# Altium schematic sheet 控制板.SchDoc (part 1 of 2) (continued)
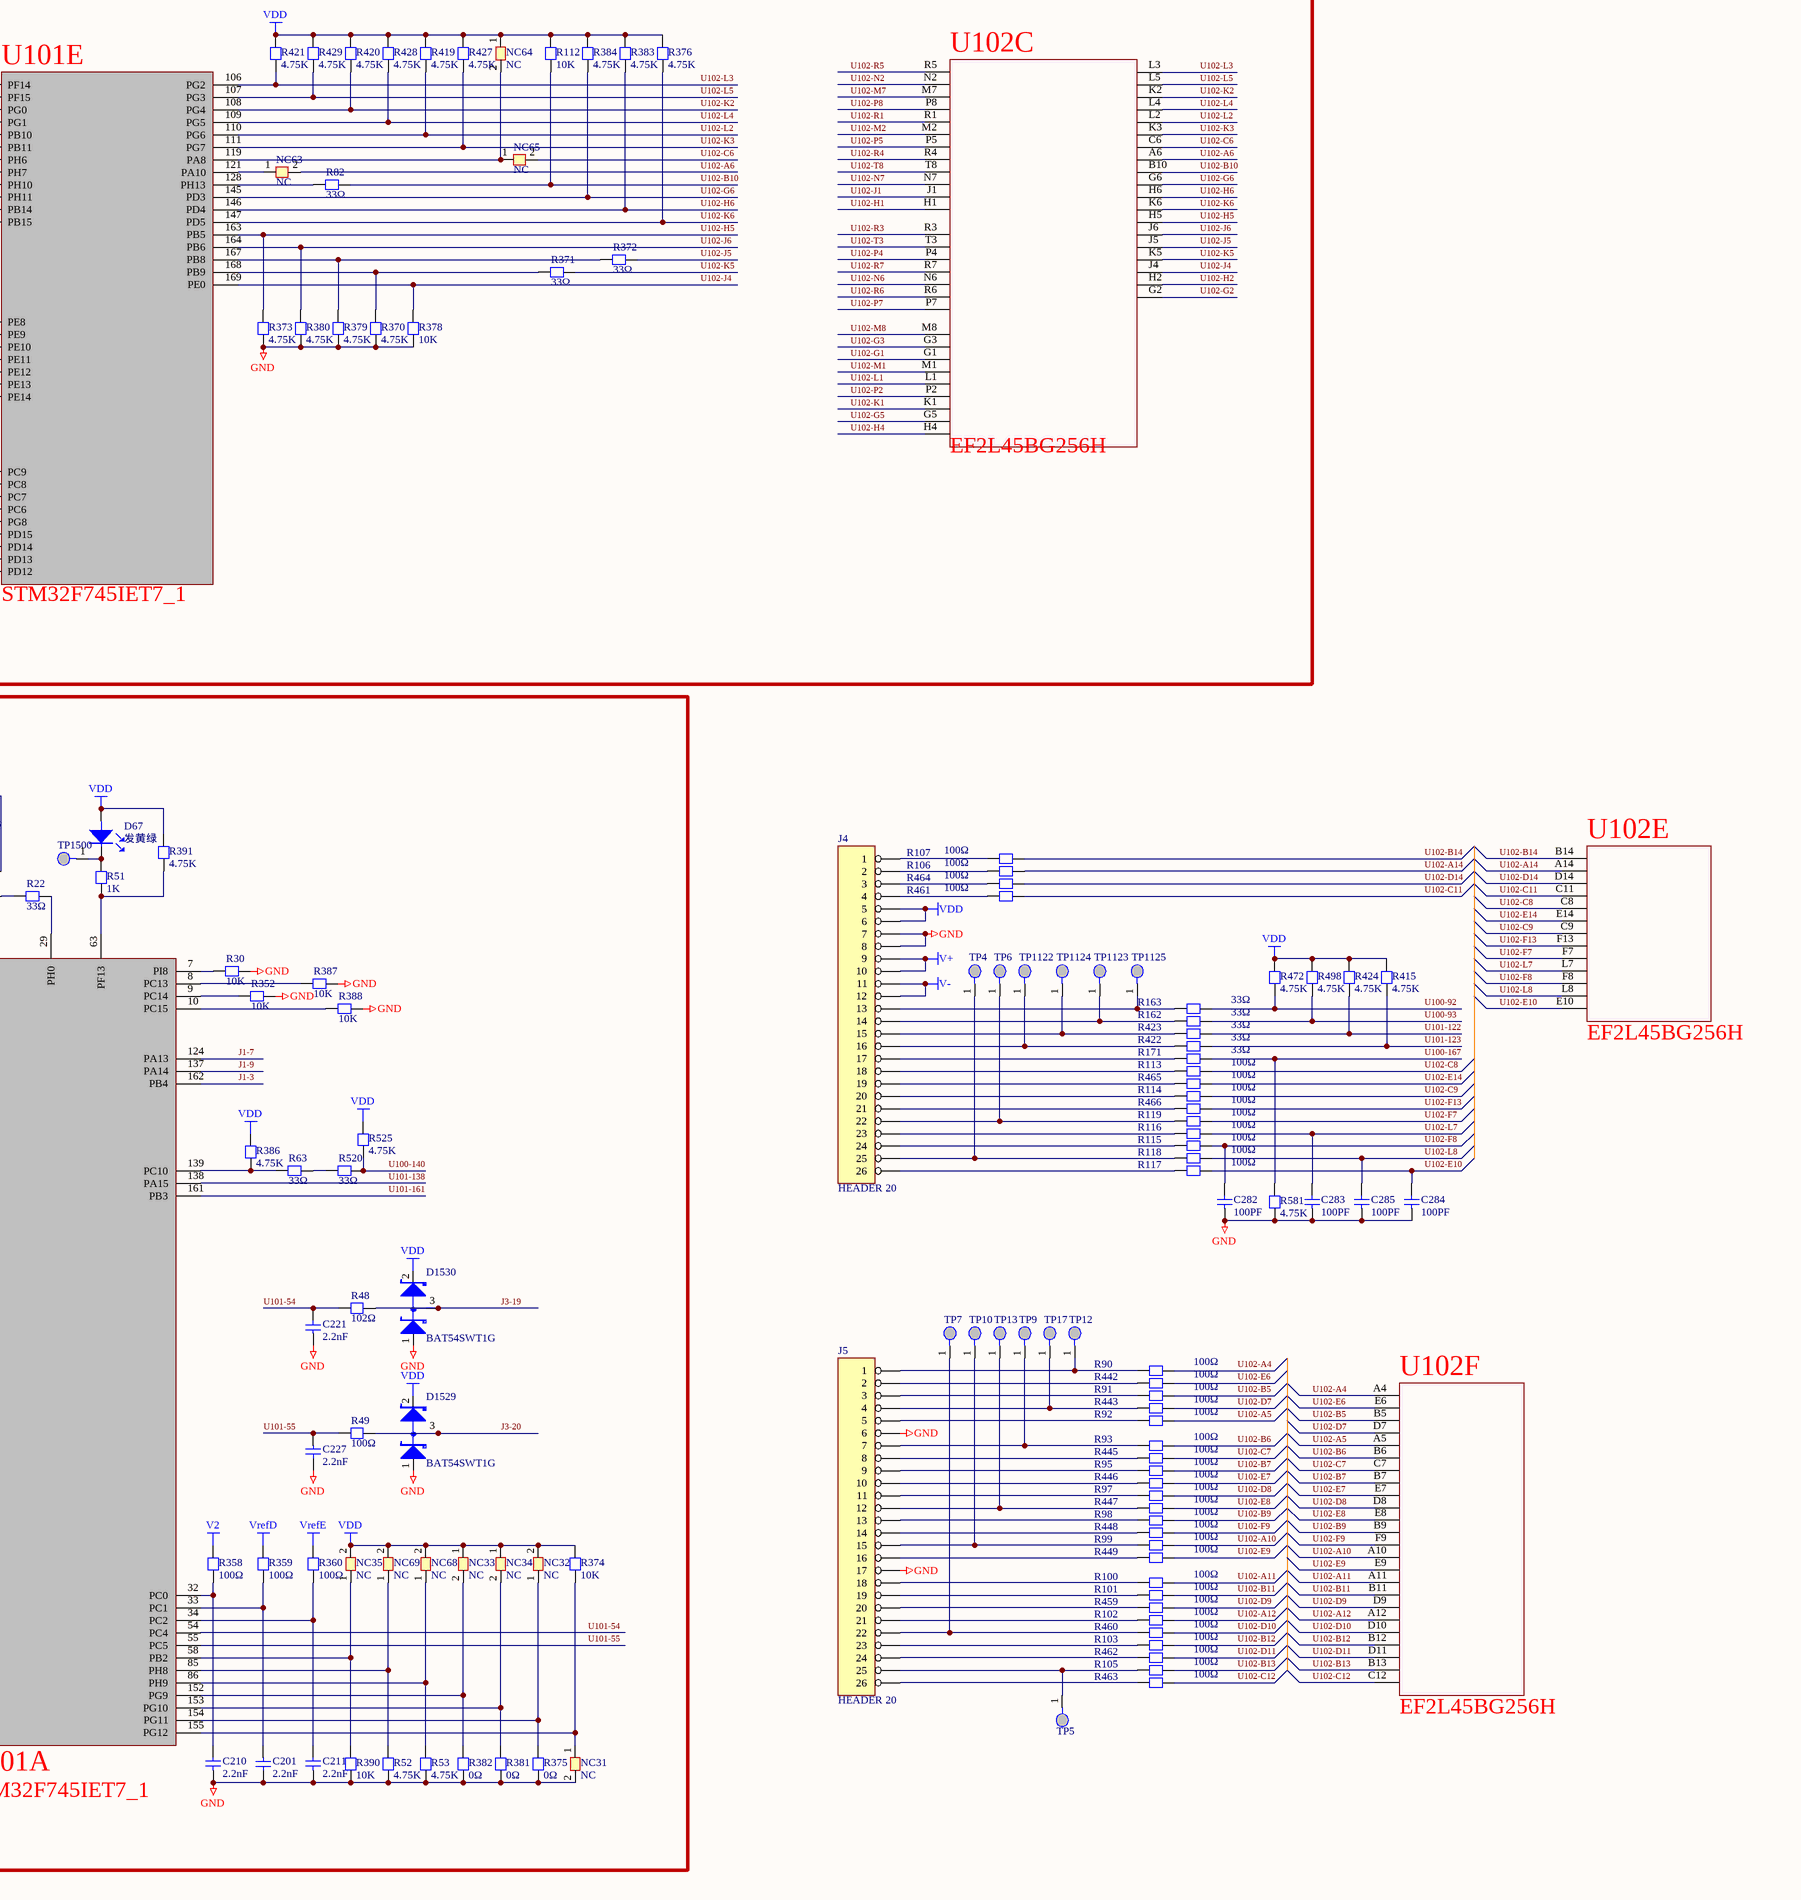
[diagram p10: 控制板.SchDoc, bottom column 3 of 4]
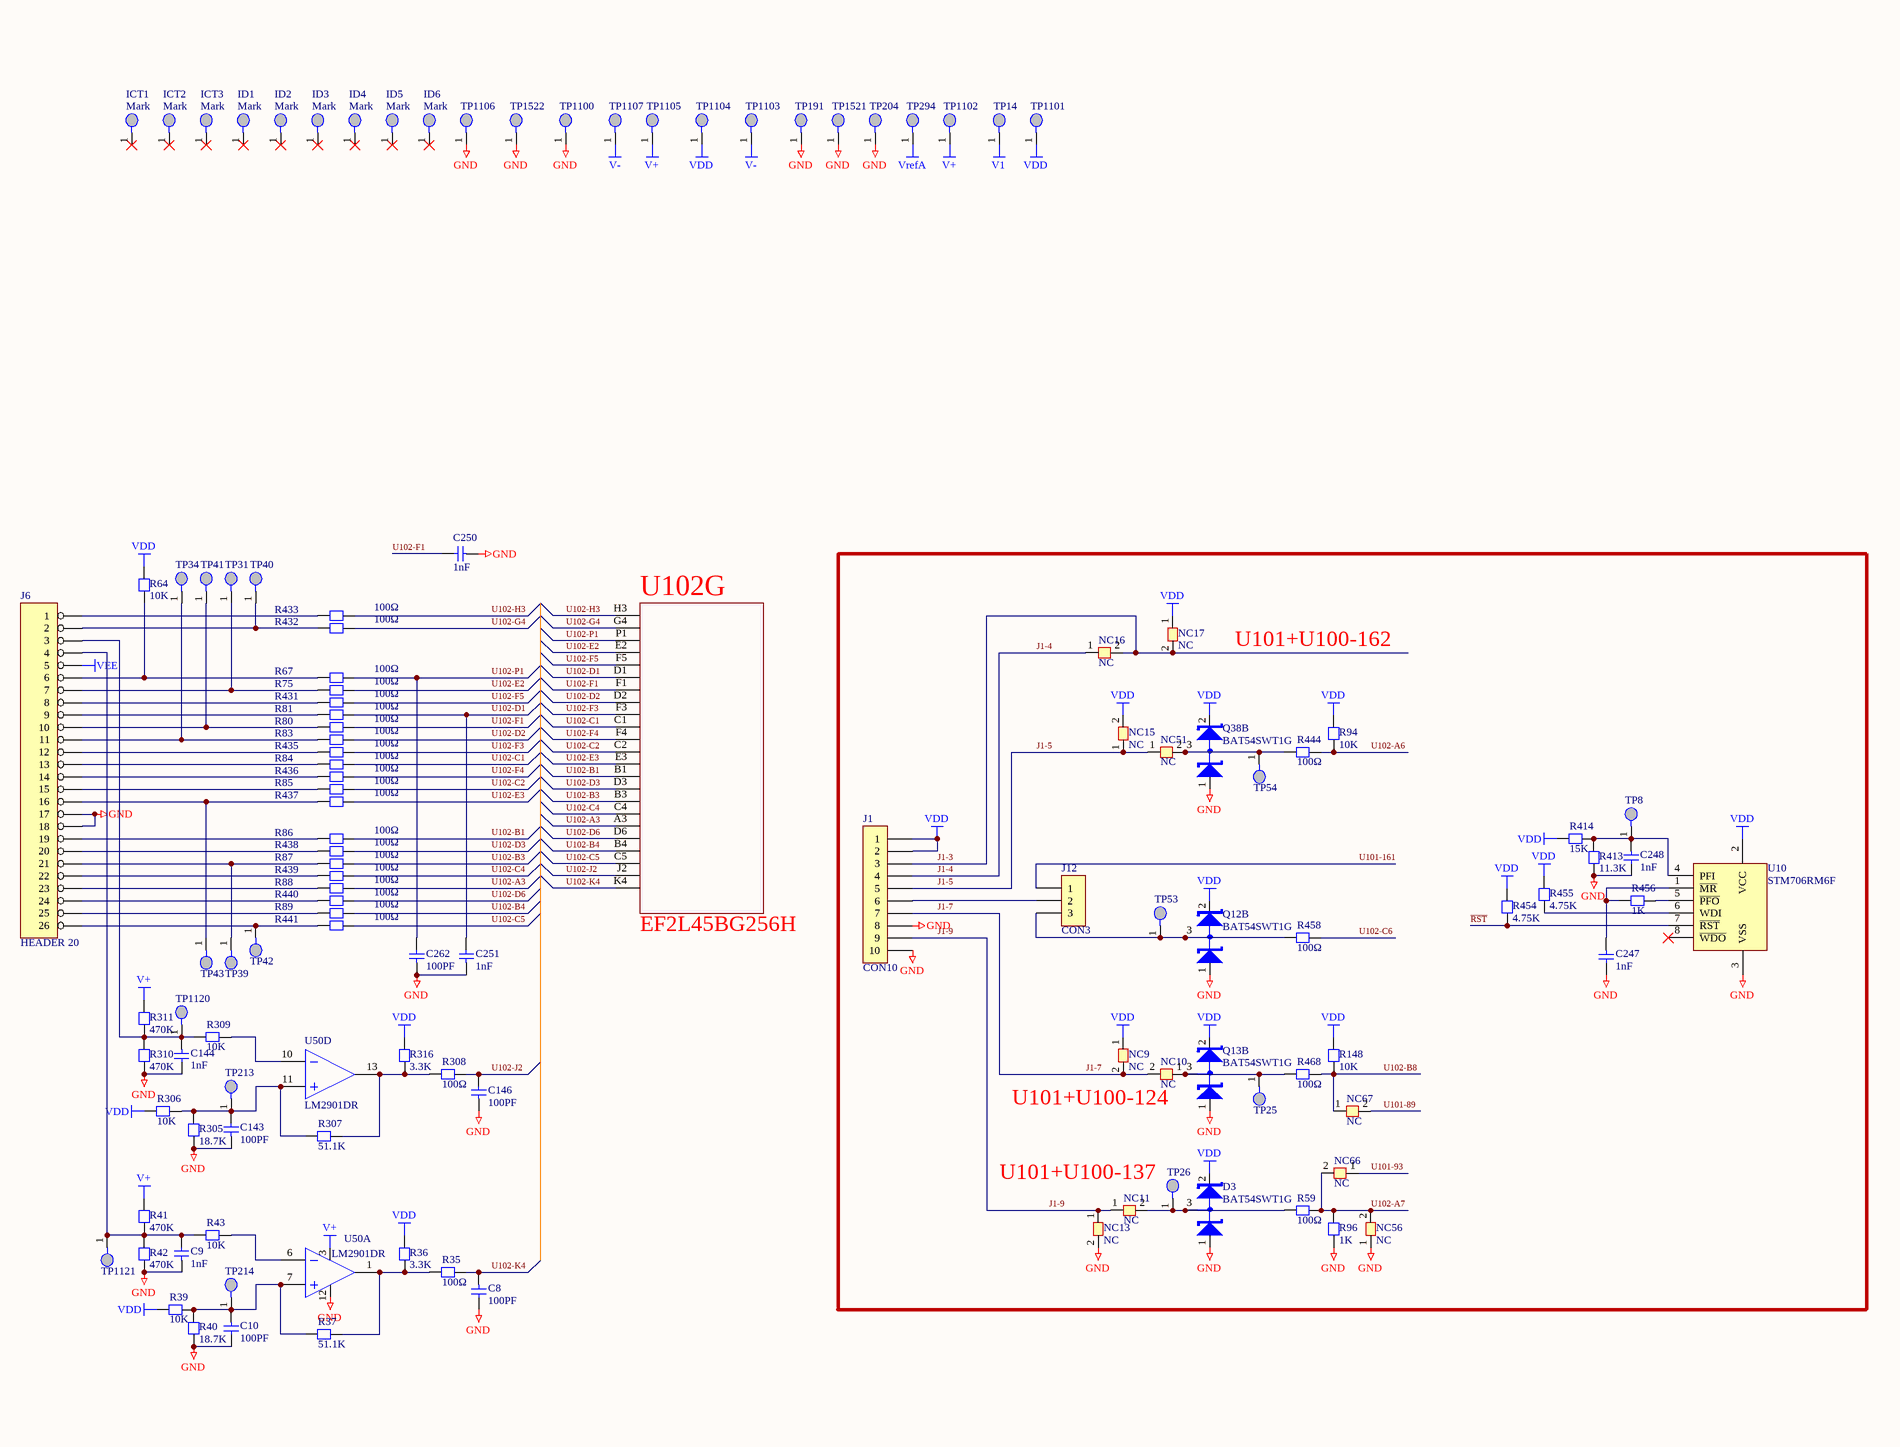
[diagram p11: 控制板.SchDoc, bottom column 4 of 4]

## Parts
C1  10uF
C2  10uF
C3  10uF
C4  100nF
C5  1uF
C6  1nF
C7  1nF
C8  100PF
C9  1nF
C10  100PF
C11  6.8uF
C12  100nF
C13  6.8uF
C14  100nF
C15  100nF
C16  100nF
C17  6.8uF
C18  1uF
C19  100nF
C20  10nF
C21  1nF
C22  100nF
C23  100nF
C24  1nF
C25  6.8uF
C26  100nF
C27  100nF
C28  24PF
C29  24PF
C30  6.8uF
C31  10uF
C32  10uF
C33  100nF
C34  100nF
C35  100PF
C36  100PF
C37  100PF
C38  24PF
C39  100nF
C40  6.8uF
C41  100nF
C42  1nF
C43  100nF
C44  10uF
C45  10uF
C46  1uF
C47  10uF
C48  10uF
C49  6.8uF
C50  100nF
C51  10nF
C52  100nF
C53  6.8uF
C54  1uF
C55  100nF
C56  6.8uF
C57  1uF
C58  2.2uF
C59  10uF
C60  100nF
C61  51PF
C62  51PF
C63  6.8uF
C64  10uF
C65  51PF
C66  51PF
C67  51PF
C68  100PF
C100  100nF
C101  100nF
C102  1uF
C103  6.8uF
C104  100nF
C105  10uF
C106  330K
C107  22nF
C108  330K
C109  22nF
C110  100nF
C111  100nF
C112  22nF
C113  330K
C114  22nF
C115  330K
C116  100nF
C117  330K
C118  22nF
C119  330K
C120  22nF
C121  10uF
C122  10uF
C123  1uF
C124  2.2uF
C125  51PF
C126  51PF
C127  100nF
C128  1nF
C129  51PF
C130  51PF
C131  100nF
C132  1nF
C133  100nF
C134  100nF
C135  1uF
C136  1nF
C137  100nF
C138  51PF
C139  51PF
C140  1nF
C141  1uF
C142  100PF
C143  100PF
C144  1nF
C145  100nF
C146  100PF
C147  1nF
C148  1nF
C149  100PF
C150  100PF
C151  100nF
C152  100nF
C153  1uF
C154  100nF
C155  24PF
C156  100PF
C157  100nF
C158  24PF
C159  100nF
C160  100nF
C161  100nF
C162  2.2uF
C163  6.8uF
C164  24PF
C165  100nF
C166  150K
C167  100nF
C168  6.8uF
C169  6.8uF
C170  2.2uF
C171  100nF
C172  9.09K
C173  100PF
C174  24PF
C175  100nF
C176  100nF
C177  9.09K
C178  100PF
C179  27PF
C180  100nF
C181  100nF
C182  9.09K
C183  100PF
C184  24PF
C185  100nF
C186  1uF
C187  100nF
C188  1uF
C189  6.8uF
C190  2.2uF
C191  100nF
C192  100nF
C193  100nF
C194  100nF
C195  100nF
C196  100nF
C197  2.2uF
C198  2.2nF
C199  2.2nF
C200  2.2nF
C201  2.2nF
C202  100nF
C203  100nF
C204  2.2nF
C205  2.2nF
C206  2.2nF
C207  100nF
C208  2.2nF
C209  2.2nF
C210  2.2nF
C211  2.2nF
C212  100nF
C213  2.2nF
C214  2.2nF
C215  2.2nF
C216  2.2nF
C217  1uF
C218  10nF
C219  2.2nF
C220  2.2nF
C221  2.2nF
C222  2.2nF
C223  2.2nF
C224  100nF
C225  2.2nF
C226  2.2nF
C227  2.2nF
C228  2.2nF
C229  100nF
C230  100nF
C231  100nF
C232  100nF
C233  2.2uF
C234  100nF
C235  100nF
C236  100nF
C237  100nF
C238  100nF
C239  100nF
C240  100nF
C241  100nF
C242  3.3uF
C243  100nF
C244  100nF
C245  100nF
C246  100nF
C247  1nF
C248  1nF
C249  100nF
C250  1nF
C251  1nF
C252  100nF
C253  100nF
C254  100nF
C255  100nF
C256  100nF
C257  100nF
C258  10uF
C259  100nF
C260  100nF
C261  100PF
C262  100PF
C263  100nF
C264  1nF
C265  100nF
C266  100nF
C267  100nF
C268  10uF
C269  100nF
C270  100nF
C271  100nF
C272  100nF
C273  100nF
C274  100nF
C275  100nF
C276  100nF
C277  100nF
C278  100nF
C279  100nF
C280  100nF
C281  100nF
C282  100PF
C283  100PF
C284  100PF
C285  100PF
C286  100PF
C287  100PF
C288  100PF
C289  100PF
C290  100PF
C300  100PF
C301  100PF
C302  100PF
C303  100PF
C304  100PF
C305  100PF
C306  100PF
C307  100PF
C308  100PF
C309  100PF
C310  100PF
C311  100PF
C312  100PF
C313  100PF
C314  100PF
C315  100PF
C316  100PF
C317  100PF
C318  100PF
C319  100PF
C320  100PF
C321  100PF
C322  100nF
C323  6.8uF
C324  2.2uF
C325  2.2uF
C326  3.3uF
C327  10uF
C328  10uF
C329  100nF
C330  1nF
C331  100nF
C332  2.2nF
C333  2.2nF
C334  2.2nF
C335  2.2nF
C336  2.2nF
C337  2.2nF
C338  2.2nF
C339  2.2nF
C340  2.2nF
C341  2.2nF
C342  2.2nF
C343  2.2nF
C344  2.2nF
C345  2.2nF
C346  2.2nF
C347  2.2nF
C348  2.2nF
C349  2.2nF
C350  1uF
C351  10nF
C352  2.2nF
C353  2.2nF
C354  2.2nF
C355  2.2nF
C356  2.2nF
C357  2.2nF
C358  10uF
C359  1nF
C360  24PF
C361  24PF
C362  100nF
C363  100nF
C364  6.8uF
C365  100nF
C366  100nF
C367  1uF
C368  100nF
C369  100PF
C370  10uF
C371  1nF
C372  1nF
C373  1nF
C374  1nF
C375  1nF
C376  1nF
C377  100nF
C378  100nF
C379  100nF
C380  6.8uF
C381  51PF
C382  1nF
C383  100nF
C384  100PF
C385  100PF
C386  9.09K
C387  1nF
C388  1nF
C389  10nF
C390  10nF
C391  10nF
C392  10nF
C393  1nF
C394  10nF
C395  10nF
C396  1nF
C397  100nF
C398  100nF
C399  10nF
C400  10nF
C401  10nF
C402  10nF
C403  100nF
C404  1nF
C405  1nF
C406  1nF
C407  1nF
C408  100nF
C409  100nF
C410  1nF
C411  51PF
C412  51PF
C413  10nF
C414  100nF
C415  10nF
C416  10nF
C417  1nF
C418  100nF
C419  1nF
C420  100nF
C421  1nF
C422  1nF
C423  10nF
C424  10nF
C425  10nF
C426  51PF
C427  51PF
C428  51PF
C429  51PF
C430  51PF
C431  51PF
C432  51PF
C433  100nF
C434  100nF
C435  51PF
C436  51PF
C437  51PF
C438  51PF
C439  51PF
C440  100nF
C441  51PF
C442  51PF
C443  51PF
C444  100nF
C445  51PF
C446  6.8uF
C447  1nF
C448  1nF
C449  10nF
C450  10nF
C451  100nF
C452  1nF
C453  100nF
C454  1nF
C455  10nF
C456  100nF
C457  100PF
C458  51PF
C459  100PF
C460  51PF
C461  51PF
C462  100PF
C463  100PF
C464  9.09K
C465  100PF
C466  51PF
C467  51PF
C468  9.09K
C469  100PF
C470  100nF
C471  9.09K
C472  9.09K
C473  100PF
C474  100PF
C475  51PF
C476  51PF
C477  100nF
C478  100PF
C479  100PF
C480  100PF
C481  51PF
C482  51PF
C483  100PF
C484  100nF
C485  100PF
C486  51PF
C487  100PF
C488  100PF
C489  9.09K
C490  9.09K
C491  9.09K
C492  51PF
C493  100PF
C494  9.09K
C495  51PF
C496  100nF
C497  10uF
C498  6.8uF
D3  BAT54SWT1G
D48  LBAV199LT1G52
D52  LBAV199LT1G52
D54  LBAV199LT1G52
D55  LBAV199LT1G52
D60  LBAV199LT1G52
D61  LBAV199LT1G52
D62  LBAV199LT1G52
D63  LBAV199LT1G52
D64  LBAV199LT1G52
D65  LBAV199LT1G52
D66  坏
D67  发黄绿
D68  LBAV199LT1G52
D69  黄绿色光
D1500  BAT54SWT1G
D1504  BAT54SWT1G
D1506  BAT54SWT1G
D1507  BAT54SWT1G
D1508  BAT54SWT1G
D1510  BAT54SWT1G
D1513  BAT54SWT1G
D1515  BAT54SWT1G
D1516  BAT54SWT1G
D1517  BAT54SWT1G
D1522  BAT54SWT1G
D1524  BAT54SWT1G
D1527  BAT54SWT1G
D1529  BAT54SWT1G
D1530  BAT54SWT1G
D1534  BAT54SWT1G
D1535  BAT54SWT1G
D1536  BAT54SWT1G
D1537  BAT54SWT1G
D1539  BAT54SWT1G
D1541  BAT54SWT1G
D1542  BAT54SWT1G
D1543  BAT54SWT1G
D1544  BAT54SWT1G
D1546  BAT54SWT1G
ICT1  Mark
ICT2  Mark
ICT3  Mark
ID1  Mark
ID2  Mark
ID3  Mark
ID4  Mark
ID5  Mark
ID6  Mark
J1  CON10
J2  HEADER 20
J3  HEADER 20
J4  HEADER 20
J5  HEADER 20
J6  HEADER 20
J7  HEADER 20
J12  CON3
LB1  560nH
LB2  680nH
LB4  680nH
LB6  680nH
NC1  NC
NC2  NC
NC3  NC
NC4  NC
NC5  NC
NC6  NC
NC7  NC
NC8  NC
NC9  NC
NC10  NC
NC11  NC
NC12  NC
NC13  NC
NC14  NC
NC15  NC
NC16  NC
NC17  NC
NC18  NC
NC19  NC
NC20  NC
NC21  NC
NC22  NC
NC23  NC
NC24  NC
NC25  NC
NC26  NC
NC27  NC
NC28  NC
NC29  NC
NC30  NC
NC31  NC
NC32  NC
NC33  NC
NC34  NC
NC35  NC
NC36  (no value)
NC37  NC
NC38  NC
NC39  NC
NC40  NC
NC41  NC
NC42  NC
NC43  NC
NC44  NC
NC45  NC
NC46  NC
NC47  NC
NC48  (no value)
NC49  NC
NC50  NC
NC51  NC
NC52  NC
NC53  NC
NC54  NC
NC55  NC
NC56  NC
NC57  NC
NC58  NC
NC59  NC3
NC60  NC3
NC61  NC
NC62  NC
NC63  NC
NC64  NC
NC65  NC
NC66  NC
NC67  NC
NC68  NC
NC69  NC
NC70  NC
NC71  NC
OSC1  12.000MHZ
OSC2  12.000MHZ
Q1B  LMBT4401LT1G
Q2  LMBT4401LT1G
Q2B  BAT54SWT1G
Q3B  BAT54SWT1G
Q4B  BAT54SWT1G
Q5B  BAT54SWT1G
Q6B  BAT54SWT1G
Q7B  BAT54SWT1G
Q8B  BAT54SWT1G
Q9  LMBT4401LT1G
Q9B  BAT54SWT1G
Q10  LMBT4401LT1G
Q10B  BAT54SWT1G
Q11  LMBT4401LT1G
Q11B  BAT54SWT1G
Q12B  BAT54SWT1G
Q13  LMBT4401LT1G
Q13B  BAT54SWT1G
Q14  LMBT4401LT1G
Q14B  BAT54SWT1G
Q15  LMBT4401LT1G
Q15B  BAT54SWT1G
Q16  LMBT4401LT1G
Q16B  BAT54SWT1G
Q17B  BAT54SWT1G
Q18B  BAT54SWT1G
Q19B  BAT54SWT1G
Q20B  BAT54SWT1G
Q21B  BAT54SWT1G
Q22B  BAT54SWT1G
Q23B  BAT54SWT1G
Q24B  BAT54SWT1G
Q25B  BAT54SWT1G
Q26B  BAT54SWT1G
Q27B  LMBT4401LT1G
Q28B  LBAV199LT1G52
Q29B  LBAV199LT1G52
Q30B  LBAV199LT1G52
Q31B  LBAV199LT1G52
Q32B  LBAV199LT1G52
Q33B  LBAV199LT1G52
Q34B  LBAV199LT1G52
Q35B  LBAV199LT1G52
Q36B  LBAV199LT1G52
Q37B  LBAV199LT1G52
Q38B  BAT54SWT1G
R1  2.2K
R2  2.2K
R3  2.2K
R4  2.2K
R5  2.2K
R6  2.2K
R7  2.2K
R8  2.2K
R9  2.2K
R10  2.2K
R11  2.2K
R12  2.2K
R13  2.2K
R14  2.2K
R15  2.2K
R16  2.2K
R17  2.2K
R18  2.2K
R19  10K
R20  1K
R21  1K
R22  33Ω
R23  1K
R24  100Ω
R25  100Ω
R26  100Ω
R27  100Ω
R28  100Ω
R29  100Ω
R30  10K
R31  33Ω
R32  33Ω
R33  33Ω
R34  33Ω
R35  100Ω
R36  3.3K
R37  51.1K
R38  100Ω
R39  10K
R40  18.7K
R41  470K
R42  470K
R43  10K
R44  100Ω
R45  100Ω
R46  100Ω
R47  100Ω
R48  102Ω
R49  100Ω
R50  100Ω
R51  1K
R52  4.75K
R53  4.75K
R54  33Ω
R55  4.75K
R56  4.75K
R57  33Ω
R58  10K
R59  100Ω
R60  4.75K
R61  33Ω
R62  33Ω
R63  33Ω
R64  10K
R65  33Ω
R66  33Ω
R67  100Ω
R68  100Ω
R69  33Ω
R70  33Ω
R71  33Ω
R72  33Ω
R73  33Ω
R74  100Ω
R75  100Ω
R76  100Ω
R77  33Ω
R78  33Ω
R79  33Ω
R80  100Ω
R81  100Ω
R82  33Ω
R83  100Ω
R84  100Ω
R85  100Ω
R86  100Ω
R87  100Ω
R88  100Ω
R89  100Ω
R90  100Ω
R91  100Ω
R92  100Ω
R93  100Ω
R94  10K
R95  100Ω
R96  1K
R97  100Ω
R98  100Ω
R99  100Ω
R100  100Ω
R101  100Ω
R102  100Ω
R103  100Ω
R104  10K
R105  100Ω
R106  100Ω
R107  100Ω
R108  4.75K
R109  33Ω
R110  33Ω
R111  4.75K
R112  10K
R113  100Ω
R114  100Ω
R115  100Ω
R116  100Ω
R117  100Ω
R118  100Ω
R119  100Ω
R120  1K
R121  100Ω
R122  100Ω
R123  33Ω
R124  33Ω
R125  4.75K
R126  1K
R127  33Ω
R128  33Ω
R129  100Ω
R130  100Ω
R131  100Ω
R132  100Ω
R133  100Ω
R134  100Ω
R135  100Ω
R136  100Ω
R137  100Ω
R138  100Ω
R139  100Ω
R140  100Ω
R141  100Ω
R142  100Ω
R143  100Ω
R144  100Ω
R145  100Ω
R146  100Ω
R147  100Ω
R148  10K
R149  100Ω
R150  100Ω
R151  102Ω
R152  100Ω
R153  100Ω
R154  102Ω
R155  100Ω
R156  100Ω
R157  100Ω
R158  33Ω
R159  33Ω
R160  33Ω
R161  33Ω
R162  33Ω
R163  33Ω
R164  33Ω
R165  33Ω
R166  33Ω
R167  270Ω
R168  100Ω
R169  4.75K
R170  1K
R171  33Ω
R172  33Ω
R173  4.75K
R174  4.75K
R175  33Ω
R176  100Ω
R177  15K
R178  15K
R179  15K
R180  15K
R181  100Ω
R182  15K
R183  15K
R184  100Ω
R185  10K
R186  10K
R187  10K
R188  10K
R189  10K
R190  10K
R191  10K
R192  10K
R193  10K
R194  10K
R195  10K
R196  10K
R197  10K
R198  10K
R199  10K
R200  10K
R250  100K
R251  1K
R252  2K
R253  2K
R254  1K
R255  100Ω
R256  10K
R257  10K
R258  1K
R259  2K
R260  2K
R261  1K
R262  1K
R263  2K
R264  2K
R265  1K
R266  10K
R267  2.43K
R268  10K
R269  11.3K
R270  18.7K
R271  6.04K
R272  6.04K
R273  100Ω
R274  18.7K
R275  11.3K
R276  11.3K
R277  18.7K
R278  11.3K
R279  18.7K
R280  10K
R281  10K
R282  1K
R283  6.04K
R284  6.04K
R285  100Ω
R286  18.7K
R287  11.3K
R288  100K
R289  100Ω
R290  6.04K
R291  6.04K
R292  18.7K
R293  11.3K
R294  10K
R295  2.43K
R296  10K
R297  10K
R298  10K
R299  2.43K
R300  10K
R301  10K
R302  1K
R303  10K
R304  0Ω
R305  18.7K
R306  10K
R307  51.1K
R308  100Ω
R309  10K
R310  470K
R311  470K
R312  10K
R313  1K
R314  1K
R315  1K
R316  3.3K
R317  1K
R318  100Ω
R319  100K
R320  1K
R321  10K
R322  1K
R323  1K
R324  18.7K
R325  10K
R326  100Ω
R327  100K
R328  1K
R329  1K
R330  18.7K
R331  1K
R332  1K
R333  100K
R334  12.1K
R335  1K
R336  1K
R337  100K
R338  12.1K
R339  1K
R340  1K
R341  100K
R342  12.1K
R343  1K
R344  33Ω
R345  33Ω
R346  33Ω
R347  33Ω
R348  4.75K
R349  4.75K
R350  4.75K
R351  4.75K
R352  10K
R353  2K
R354  4.75K
R355  100Ω
R356  100Ω
R357  100Ω
R358  100Ω
R359  100Ω
R360  100Ω
R361  100Ω
R362  100Ω
R363  100Ω
R364  100Ω
R365  100Ω
R366  100Ω
R367  10K
R368  100Ω
R369  10K
R370  4.75K
R371  33Ω
R372  33Ω
R373  4.75K
R374  10K
R375  0Ω
R376  4.75K
R377  4.75K
R378  10K
R379  4.75K
R380  4.75K
R381  0Ω
R382  0Ω
R383  4.75K
R384  4.75K
R385  4.75K
R386  4.75K
R387  10K
R388  10K
R389  2K
R390  10K
R391  4.75K
R392  4.75K
R393  4.75K
R394  4.75K
R395  4.75K
R396  100Ω
R397  4.75K
R398  4.75K
R399  4.75K
R400  4.75K
R401  4.75K
R402  4.75K
R403  4.75K
R404  4.75K
R405  4.75K
R406  4.75K
R407  4.75K
R408  4.75K
R409  4.75K
R410  4.75K
R411  4.75K
R412  4.75K
R413  11.3K
R414  15K
R415  4.75K
R416  4.75K
R417  4.75K
R418  4.75K
R419  4.75K
R420  4.75K
R421  4.75K
R422  33Ω
R423  33Ω
R424  4.75K
R425  4.75K
R426  4.75K
R427  4.75K
R428  4.75K
R429  4.75K
R430  4.75K
R431  100Ω
R432  100Ω
R433  100Ω
R434  33Ω
R435  100Ω
R436  100Ω
R437  100Ω
R438  100Ω
R439  100Ω
R440  100Ω
R441  100Ω
R442  100Ω
R443  100Ω
R444  100Ω
R445  100Ω
R446  100Ω
R447  100Ω
R448  100Ω
R449  100Ω
R450  33Ω
R451  4.75K
R452  4.75K
R453  100Ω
R454  4.75K
R455  4.75K
R456  1K
R457  10K
R458  100Ω
R459  100Ω
R460  100Ω
R461  100Ω
R462  100Ω
R463  100Ω
R464  100Ω
R465  100Ω
R466  100Ω
R467  10K
R468  100Ω
R469  33Ω
R470  33Ω
R471  4.75K
R472  4.75K
R473  4.75K
R474  4.75K
R475  4.75K
R476  4.75K
R477  4.75K
R478  4.75K
R479  4.75K
R480  4.75K
R481  4.75K
R482  4.75K
R483  4.75K
R484  33Ω
R485  33Ω
R486  33Ω
R487  33Ω
R488  4.75K
R489  33Ω
R490  4.75K
R491  33Ω
R492  4.75K
R493  4.75K
R494  4.75K
R495  4.75K
R496  4.75K
R497  4.75K
R498  4.75K
R499  4.75K
R500  4.75K
R501  4.75K
R502  4.75K
R503  4.75K
R504  4.75K
R505  4.75K
R506  4.75K
R507  4.75K
R508  4.75K
R509  4.75K
R510  4.75K
R511  4.75K
R512  4.75K
R513  4.75K
R514  4.75K
R515  4.75K
R516  4.75K
R517  4.75K
R518  4.75K
R519  33Ω
R520  33Ω
R521  33Ω
R522  4.75K
R523  4.75K
R524  33Ω
R525  4.75K
R526  4.75K
R527  4.75K
R528  4.75K
R529  4.75K
R530  4.75K
R531  4.75K
R532  4.75K
R533  4.75K
R534  4.75K
R535  4.75K
R536  4.75K
R537  4.75K
R538  4.75K
R539  4.75K
R540  10K
R541  270Ω
R542  2.43K
R543  2K
R544  100Ω
R545  100Ω
R546  100Ω
R547  100Ω
R548  100Ω
R549  100Ω
R550  10K
R551  100Ω
R552  100Ω
R553  1K
R554  100Ω
R555  100Ω
R556  100Ω
R557  100Ω
R558  100Ω
R559  100Ω
R560  100Ω
R561  100Ω
R562  100Ω
R563  33Ω
R564  2K
R565  10K
R566  10K
R567  100Ω
R568  100Ω
R569  100Ω
R570  100Ω
R571  100Ω
R572  100Ω
R573  33Ω
R574  4.75K
R575  2K
R576  33Ω
R577  10K
R578  10K
R579  4.75K
R580  10K
R581  4.75K
R582  10K
R583  4.75K
R584  4.75K
R585  4.75K
R586  4.75K
R587  4.75K
R588  33Ω
R589  33Ω
R590  10K
R591  10K
R592  100K
R593  1K
R594  10K
R595  2.43K
R596  10K
R597  10K
R598  100Ω
R599  100Ω
R600  100Ω
R601  100Ω
R602  100Ω
R603  100Ω
R604  20K
R605  100K
R606  10K
R607  10K
R608  4.75K
R609  4.75K
R610  7.5K
R611  10K
R612  100K
R613  100K
R614  12.1K
R615  10K
R616  10K
R617  10K
R618  10K
R619  10K
R620  2.43K
R621  10K
R622  10K
R623  2.43K
R624  10K
R625  10K
R626  2.43K
R627  10K
R628  15K
R629  15K
R630  15K
R631  15K
R632  100Ω
R633  100Ω
R634  100Ω
R635  100Ω
R636  10K
R637  10K
R638  10K
R639  10K
R640  6.04K
R641  8.2K
R642  6.04K
R643  8.2K
R644  4.75K
R645  15K
R646  100Ω
R647  10K
R648  15K
R649  10K
R650  10K
R651  15K
R652  100Ω
R653  100Ω
R654  4.75K
R655  4.75K
R656  15K
R657  10K
R658  4.75K
R659  4.75K
R660  100Ω
R661  100Ω
R662  15K
R663  10K
R664  10K
R665  10K
R666  10K
R667  10K
R668  10K
R669  10K
R670  10K
R671  100K
R672  4.75K
R673  4.75K
R674  100K
R675  10K
R676  10K
R677  10K
R678  10K
R679  10K
R680  100K
R681  4.75K
R682  4.75K
R683  100K
R684  10K
R685  100Ω
R686  6.04K
R687  8.2K
R688  6.04K
R689  6.04K
R690  8.2K
R691  6.04K
R692  8.2K
R693  8.2K
R694  6.04K
R695  8.2K
R696  6.04K
R697  6.04K
R698  8.2K
R699  8.2K
R700  8.2K
R701  6.04K
R702  6.04K
R703  8.2K
R704  8.2K
R705  6.04K
R706  8.2K
R707  6.04K
R708  6.04K
R709  8.2K
R710  6.04K
R711  8.2K
R712  8.2K
R713  8.2K
R714  6.04K
R715  6.04K
R716  8.2K
R717  6.04K
R718  10K
R719  15K
R720  100Ω
R721  100Ω
R722  15K
R723  4.75K
R724  4.75K
R725  10K
R726  10K
R727  4.75K
R728  4.75K
R729  15K
R730  100Ω
R731  100Ω
R732  15K
R733  10K
R734  100K
R735  4.75K
R736  4.75K
R737  100K
R738  100K
R739  4.75K
R740  4.75K
R741  100K
R742  10K
R743  10K
R744  7.5K
R745  7.5K
R746  10K
R747  12.1K
R748  12.1K
R749  7.5K
R750  12K
R751  10K
R752  10K
R753  10K
R754  10K
R755  10K
R756  10K
R757  100K
R758  4.75K
R759  4.75K
R760  100K
R761  7.5K
R762  12.1K
R763  100K
R764  4.75K
R765  4.75K
R766  100K
R767  10K
R768  7.5K
R769  12.1K
R770  10K
R771  7.5K
R772  12.1K
R773  10K
R774  10K
R775  10K
R776  10K
R777  10K
R778  10K
R779  10K
R780  12.1K
R781  12.1K
R782  7.5K
R783  7.5K
R784  100K
R785  4.75K
R786  4.75K
R787  100K
R788  100K
R789  4.75K
R790  4.75K
R791  100K
R792  10K
R793  10K
R794  10K
R795  10K
R796  10K
R797  10K
R798  10K
R799  10K
R800  10K
R801  10K
R802  10K
R803  10K
R804  10K
TP1  (no value)
TP2  (no value)
TP3  (no value)
TP4  (no value)
TP5  (no value)
TP6  (no value)
TP7  (no value)
TP8  (no value)
TP9  (no value)
TP10  (no value)
TP11  (no value)
TP12  (no value)
TP13  (no value)
TP14  (no value)
TP15  (no value)
TP16  (no value)
TP17  (no value)
TP18  (no value)
TP19  (no value)
TP20  (no value)
TP21  (no value)
TP22  (no value)
TP23  (no value)
TP24  (no value)
TP25  (no value)
TP26  (no value)
TP27  (no value)
TP28  (no value)
TP29  (no value)
TP30  (no value)
TP31  (no value)
TP32  (no value)
TP33  (no value)
TP34  (no value)
TP35  (no value)
TP36  (no value)
TP37  (no value)
TP38  (no value)
TP39  (no value)
TP40  (no value)
TP41  (no value)
TP42  (no value)
TP43  (no value)
TP44  (no value)
TP45  (no value)
TP46  (no value)
TP47  (no value)
TP48  (no value)
TP49  (no value)
TP50  (no value)
TP51  (no value)
TP52  (no value)
TP53  (no value)
TP54  (no value)
TP55  (no value)
TP58  (no value)
TP59  (no value)
TP60  (no value)
TP61  (no value)
TP64  (no value)
TP150  (no value)
TP151  (no value)
TP152  (no value)
TP153  (no value)
TP191  (no value)
TP204  (no value)
TP209  (no value)
TP213  (no value)
TP214  (no value)
TP277  (no value)
TP278  (no value)
TP279  (no value)
TP280  (no value)
TP281  (no value)
TP282  (no value)
TP294  (no value)
TP316  (no value)
TP317  (no value)
TP318  (no value)
TP319  (no value)
TP500  (no value)
TP501  (no value)
TP502  (no value)
TP503  (no value)
TP504  (no value)
TP505  (no value)
TP506  (no value)
TP507  (no value)
TP508  (no value)
TP510  (no value)
TP511  (no value)
TP512  (no value)
TP513  (no value)
TP514  (no value)
TP515  (no value)
TP516  (no value)
TP517  (no value)
TP1100  (no value)
TP1101  (no value)
TP1102  (no value)
TP1103  (no value)
TP1104  (no value)
TP1105  (no value)
TP1106  (no value)
TP1107  (no value)
TP1120  (no value)
TP1121  (no value)
TP1122  (no value)
TP1123  (no value)
TP1124  (no value)
TP1125  (no value)
TP1202  (no value)
TP1203  (no value)
TP1500  (no value)
TP1502  (no value)
TP1503  (no value)
TP1504  (no value)
TP1505  (no value)
TP1506  (no value)
TP1507  (no value)
TP1508  (no value)
TP1509  (no value)
TP1510  (no value)
TP1511  (no value)
TP1512  (no value)
TP1513  (no value)
TP1514  (no value)
TP1515  (no value)
TP1516  (no value)
TP1517  (no value)
TP1518  (no value)
TP1520  (no value)
TP1521  (no value)
TP1522  (no value)
U1  74HC4051D
U2  74HC4051D
U3  NC
U4  74HC4051D
U5  TL431BQDBZR
U7  74HC4051D
U9  12
U10  STM706RM6F
U11  30
U12  30
U13  NC  (parts A,B,C,D of 4)
U16  LM211DT
U17  LM211DT
U18  LM211DT
U19  LM211DT
U20  LM211DT
U21  LM211DT
U24  M24128-BWMN6TP
U25  M24128-BWMN6TP
U26  N
U27  NC
U29  LM4040AIM3-2.5
U30  NC
U36  30
U50  LM2901DR  (parts A,B,C,D of 4)
U100  STM32F745IET7  (parts A,B,C,D,E of 5)
U101  STM32F745IET7_1  (parts A,B,C,D,E of 5)
U102  EF2L45BG256H  (parts A,B,C,D,E,F,G,H,I of 9)
U203  LM2901DR  (parts A,B,C,D of 4)
U206  LM2901DR  (parts A,B,C,D of 4)
U211  LM2901DR  (parts A,B,C,D of 4)
U212  LM2901DR  (parts A,B,C,D of 4)
U213  LM2901DR  (parts A,B,C,D of 4)
U300  TS9224IDT  (parts A,B,C,D of 4)
U301  TL084AIDR  (parts A,B,C,D of 4)
U302  TL084AIDR  (parts A,B,C,D of 4)
U303  TL084AIDR  (parts A,B,C,D of 4)
U304  TL084AIDR  (parts A,B,C,D of 4)
U306  TL084AIDR  (parts A,B,C,D of 4)
U307  TL084AIDR  (parts A,B,C,D of 4)
U313  TL084AIDR  (parts A,B,C,D of 4)
U320  TL084AIDR  (parts A,B,C,D of 4)
U321  TL084AIDR  (parts A,B,C,D of 4)

## Blocks framed on the sheet
J6-5: C11-C13 C15-C22 C26 C27 C31-C34 C39 C43-C45 C47-C56 C58-C60 C63 C64 C101 C103 C104 C110 C116 C124 C127 C131 C133 C137 C152 C154 C157 C159 C160 C162 C163 C165 C167-C171 C175 C176 C180 C181 C185 C189-C197 C202 C203 C207 C212 C224 C229-C246 C249 C252-C260 C263 C265-C281 C323-C331 C358 C362 C364 C366 C368 C370 C377-C380 C383 C397 C398 C403 C408 C409 C414 C418 C420 C433 C434 C440 C444 C446 C451 C453 C456 C470 C477 C484 C496 C498 LB2 LB4 NC1 NC3 NC5 NC21 NC50 NC52-NC55 NC57 NC58 NC62 R23 R58 R167 R367 R369 R541-R543 R550 R553 R580 R582 R615-R618 TP16 U5 U100-U102 U203